# EasyEDA Pro project Foc驱动板.eprj, schematic Schematic2

## Sheets
1 MCU: Board Name: FocDriverV2; Create Date: 2026-02-18; Page Name: MCU; Project Name: Foc驱动板; Schematic Name: Schematic2; Update Date: 2026-02-18; Company: 嘉立创EDA; Page Size: A4; Version: V1.0
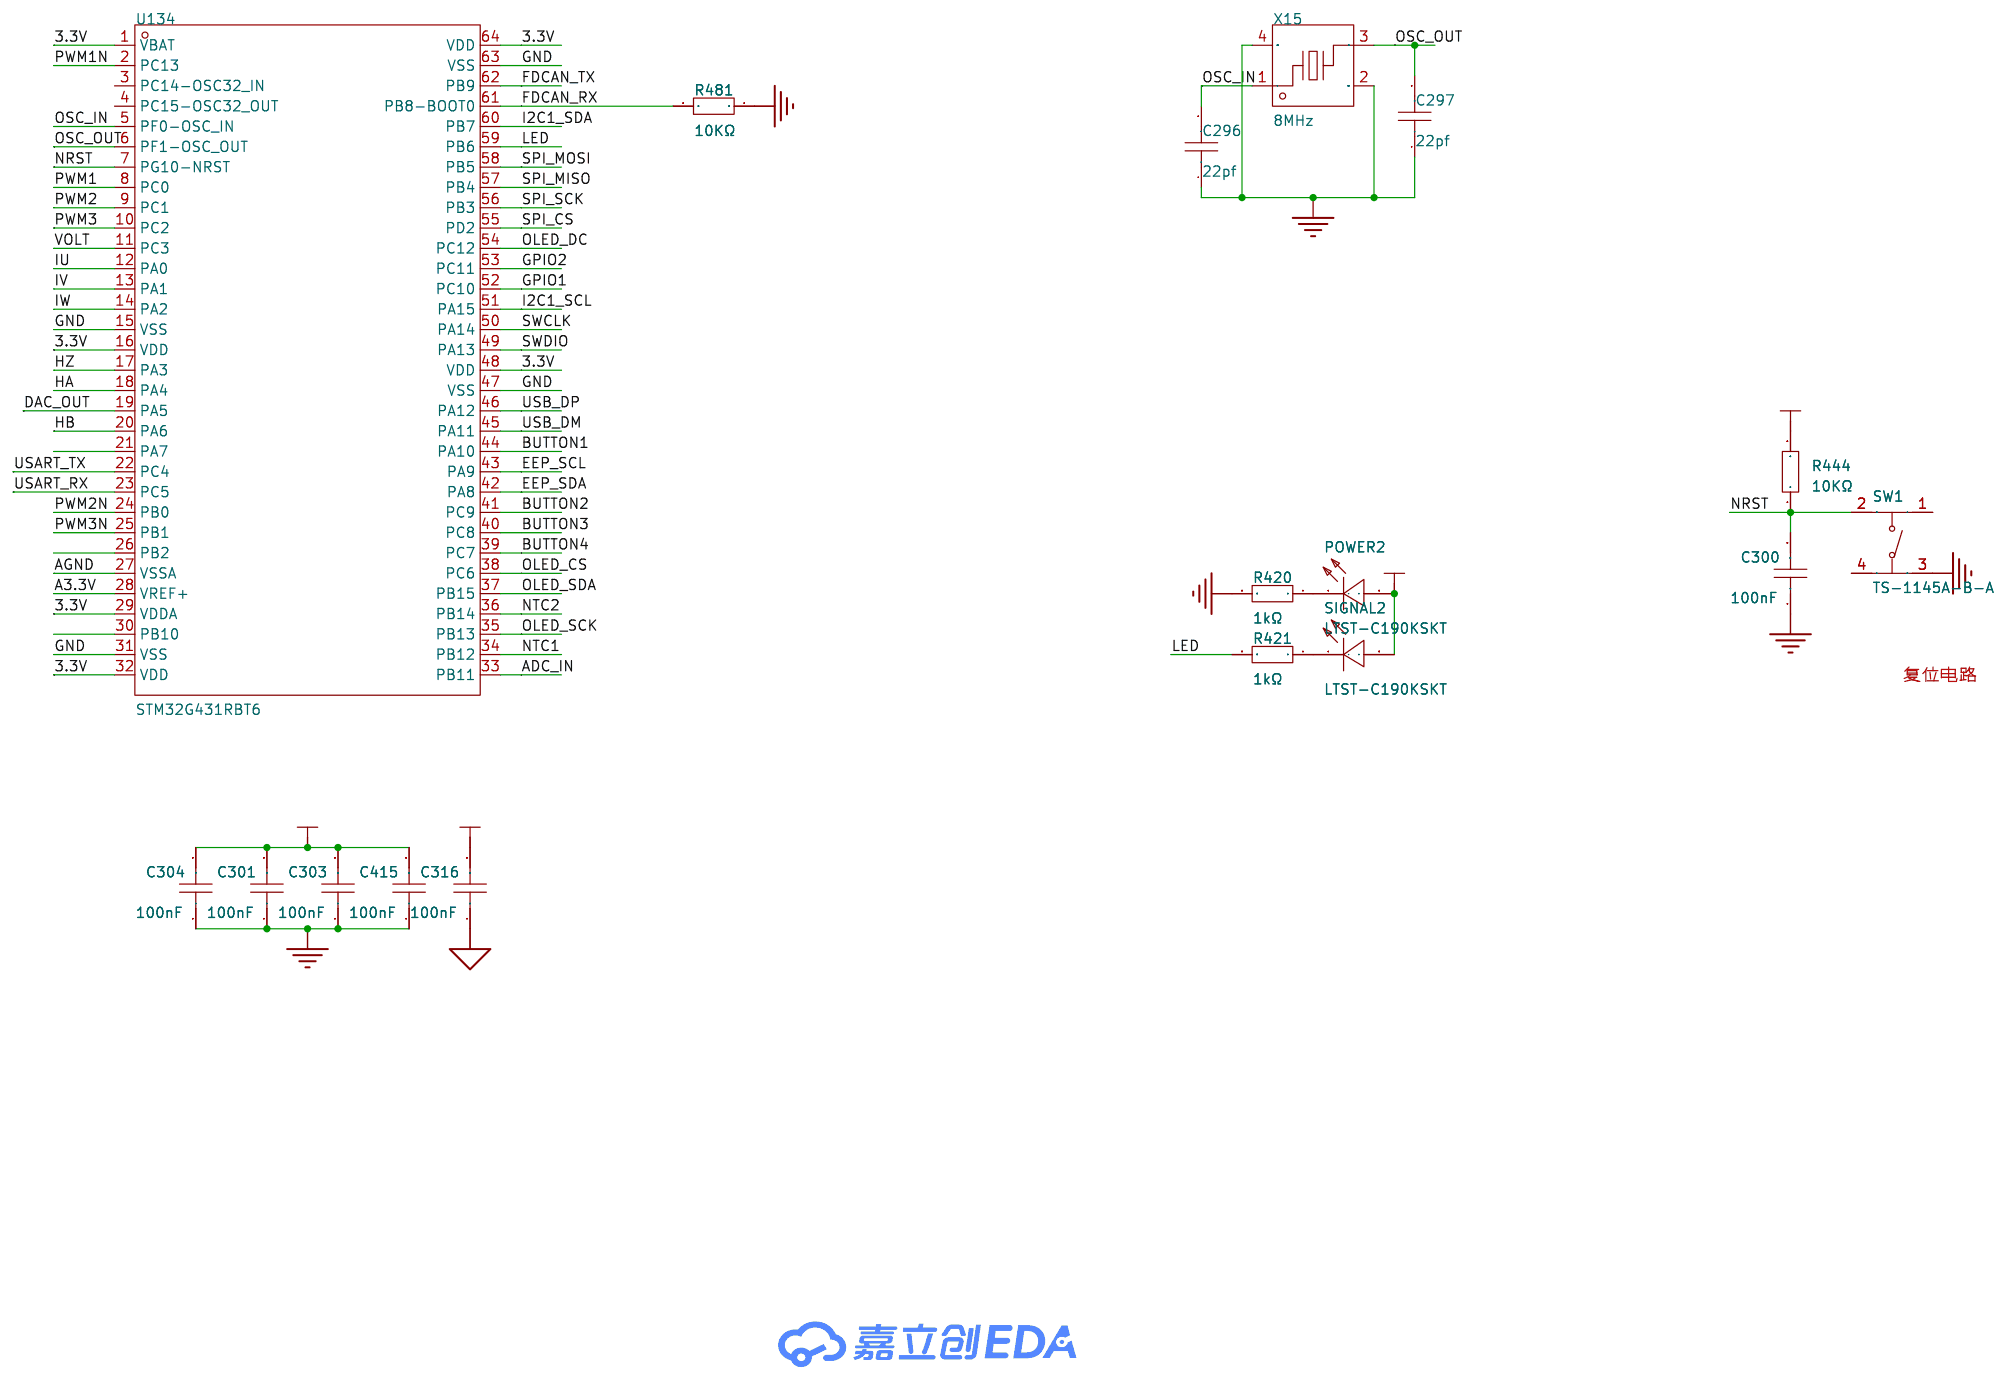
[diagram p3: MCU]
2 逆变电路: Page Name: 逆变电路
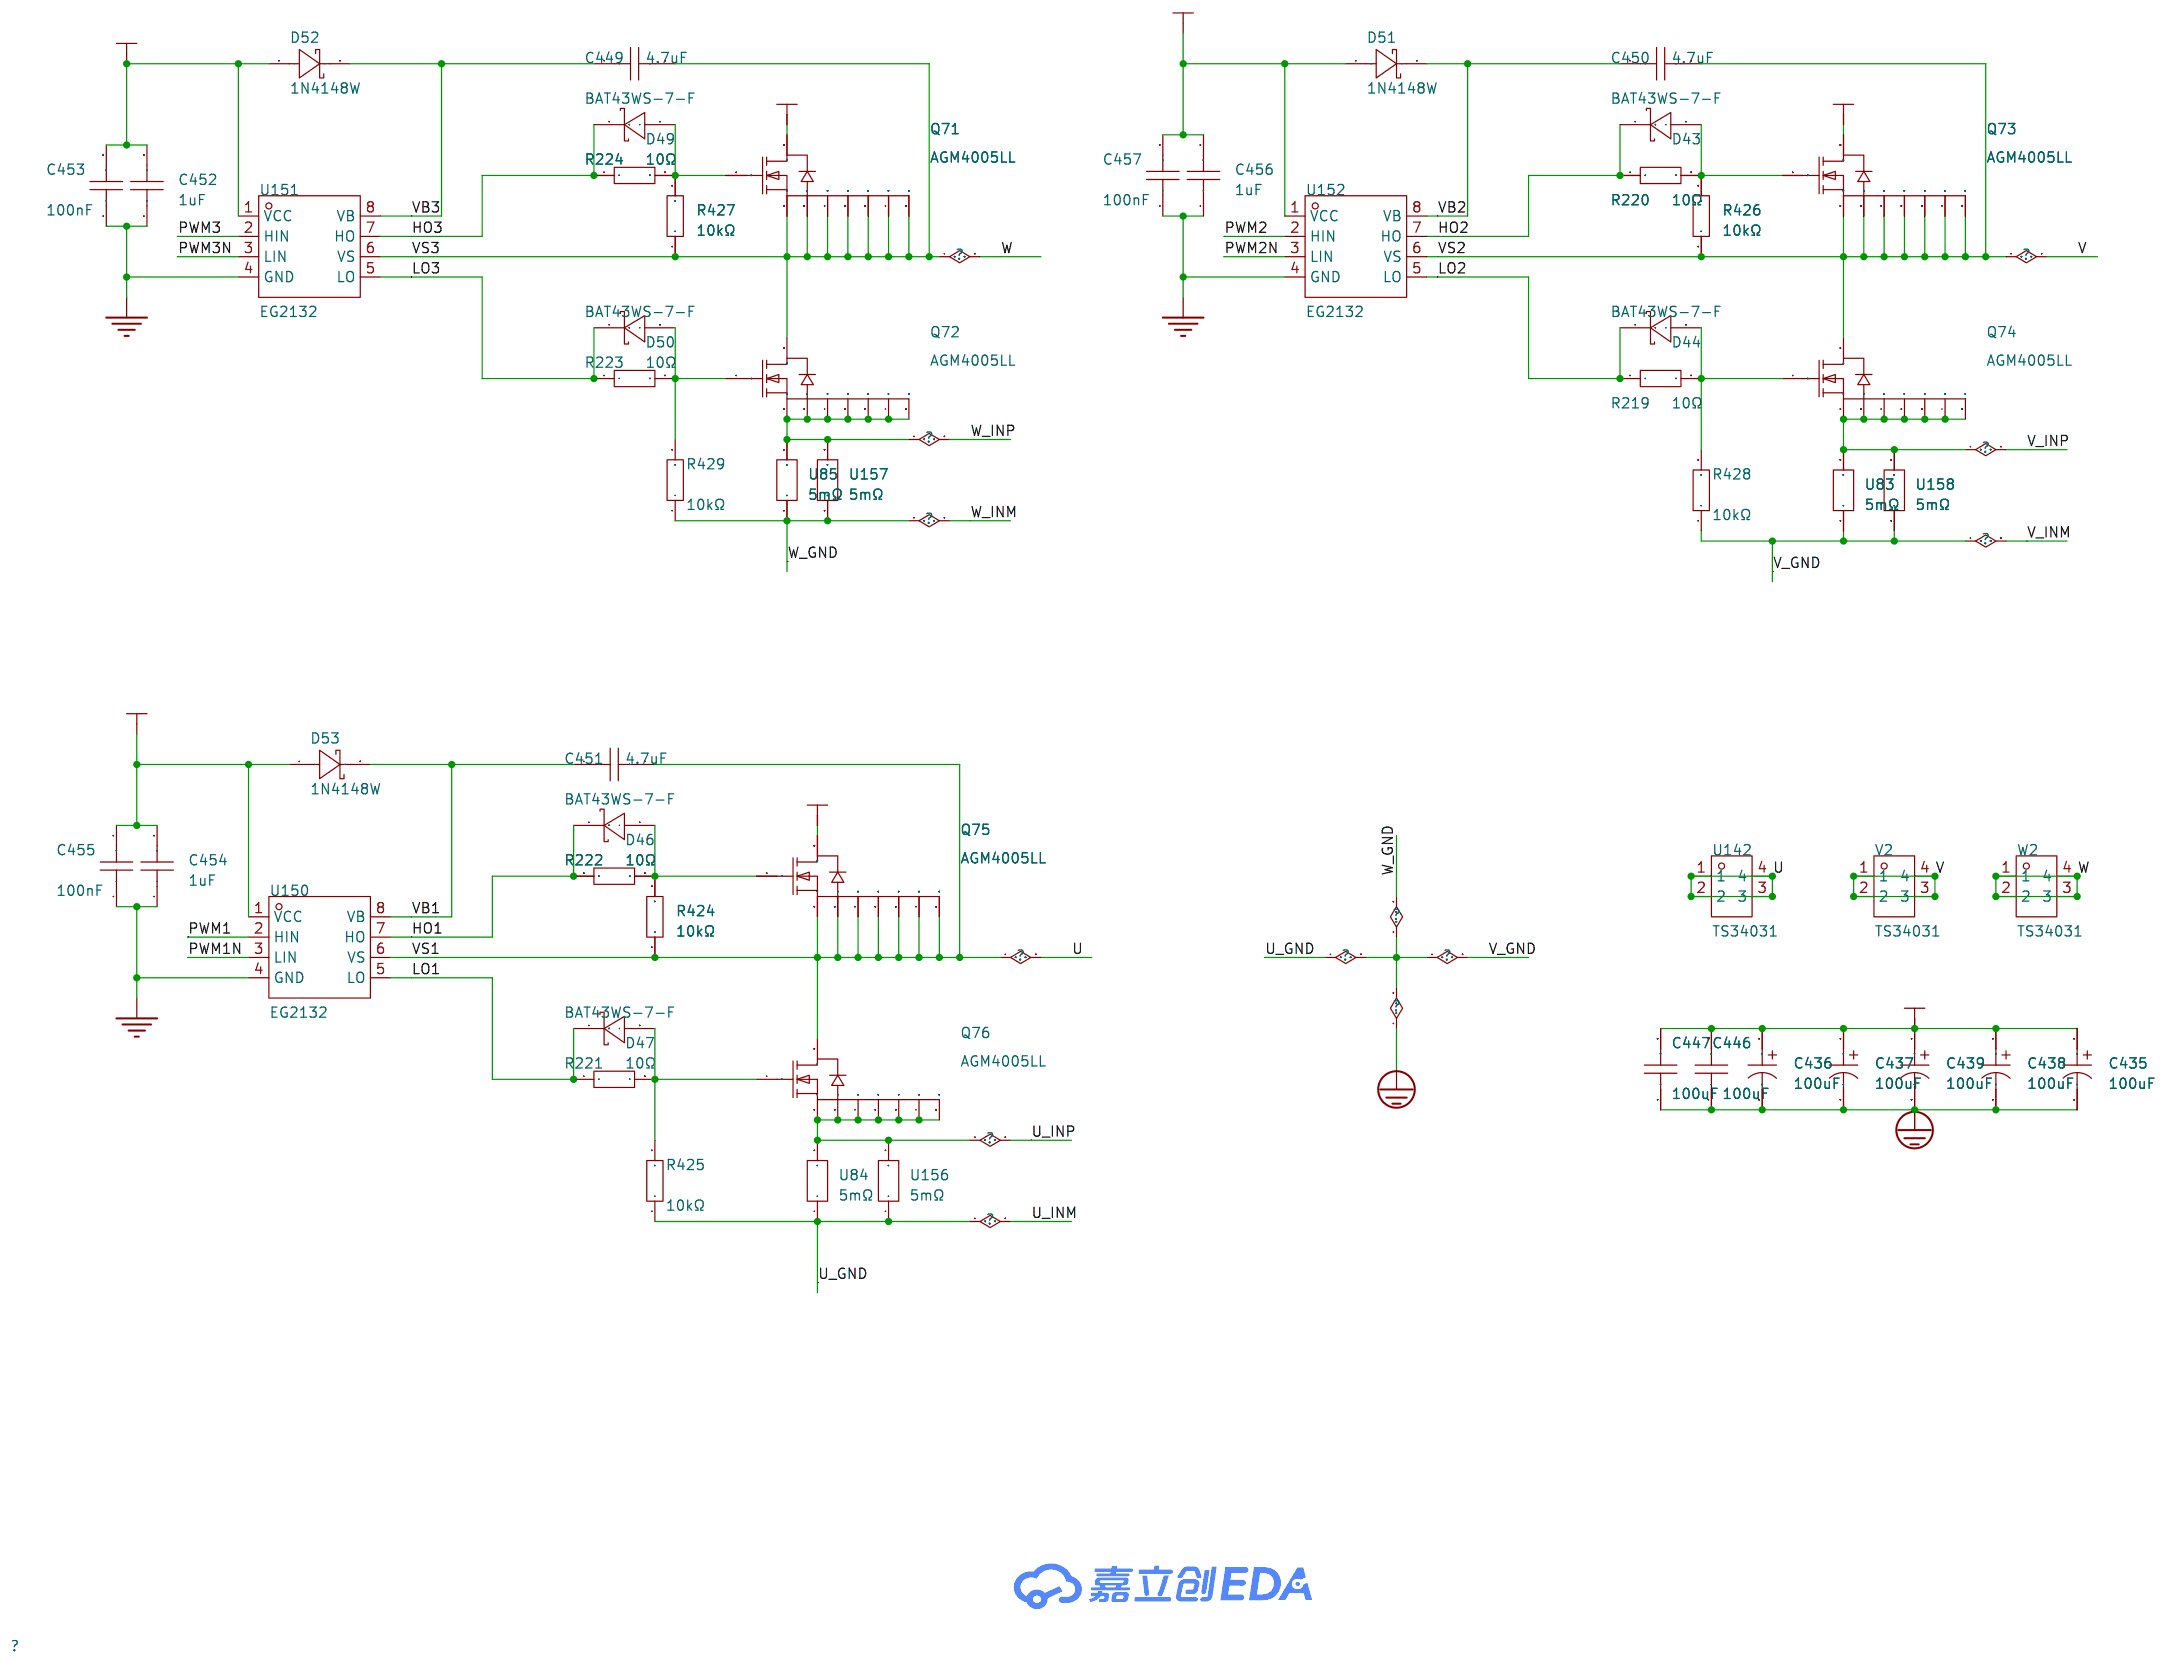
[diagram p4: 逆变电路]
3 采样电路: Page Name: 采样电路
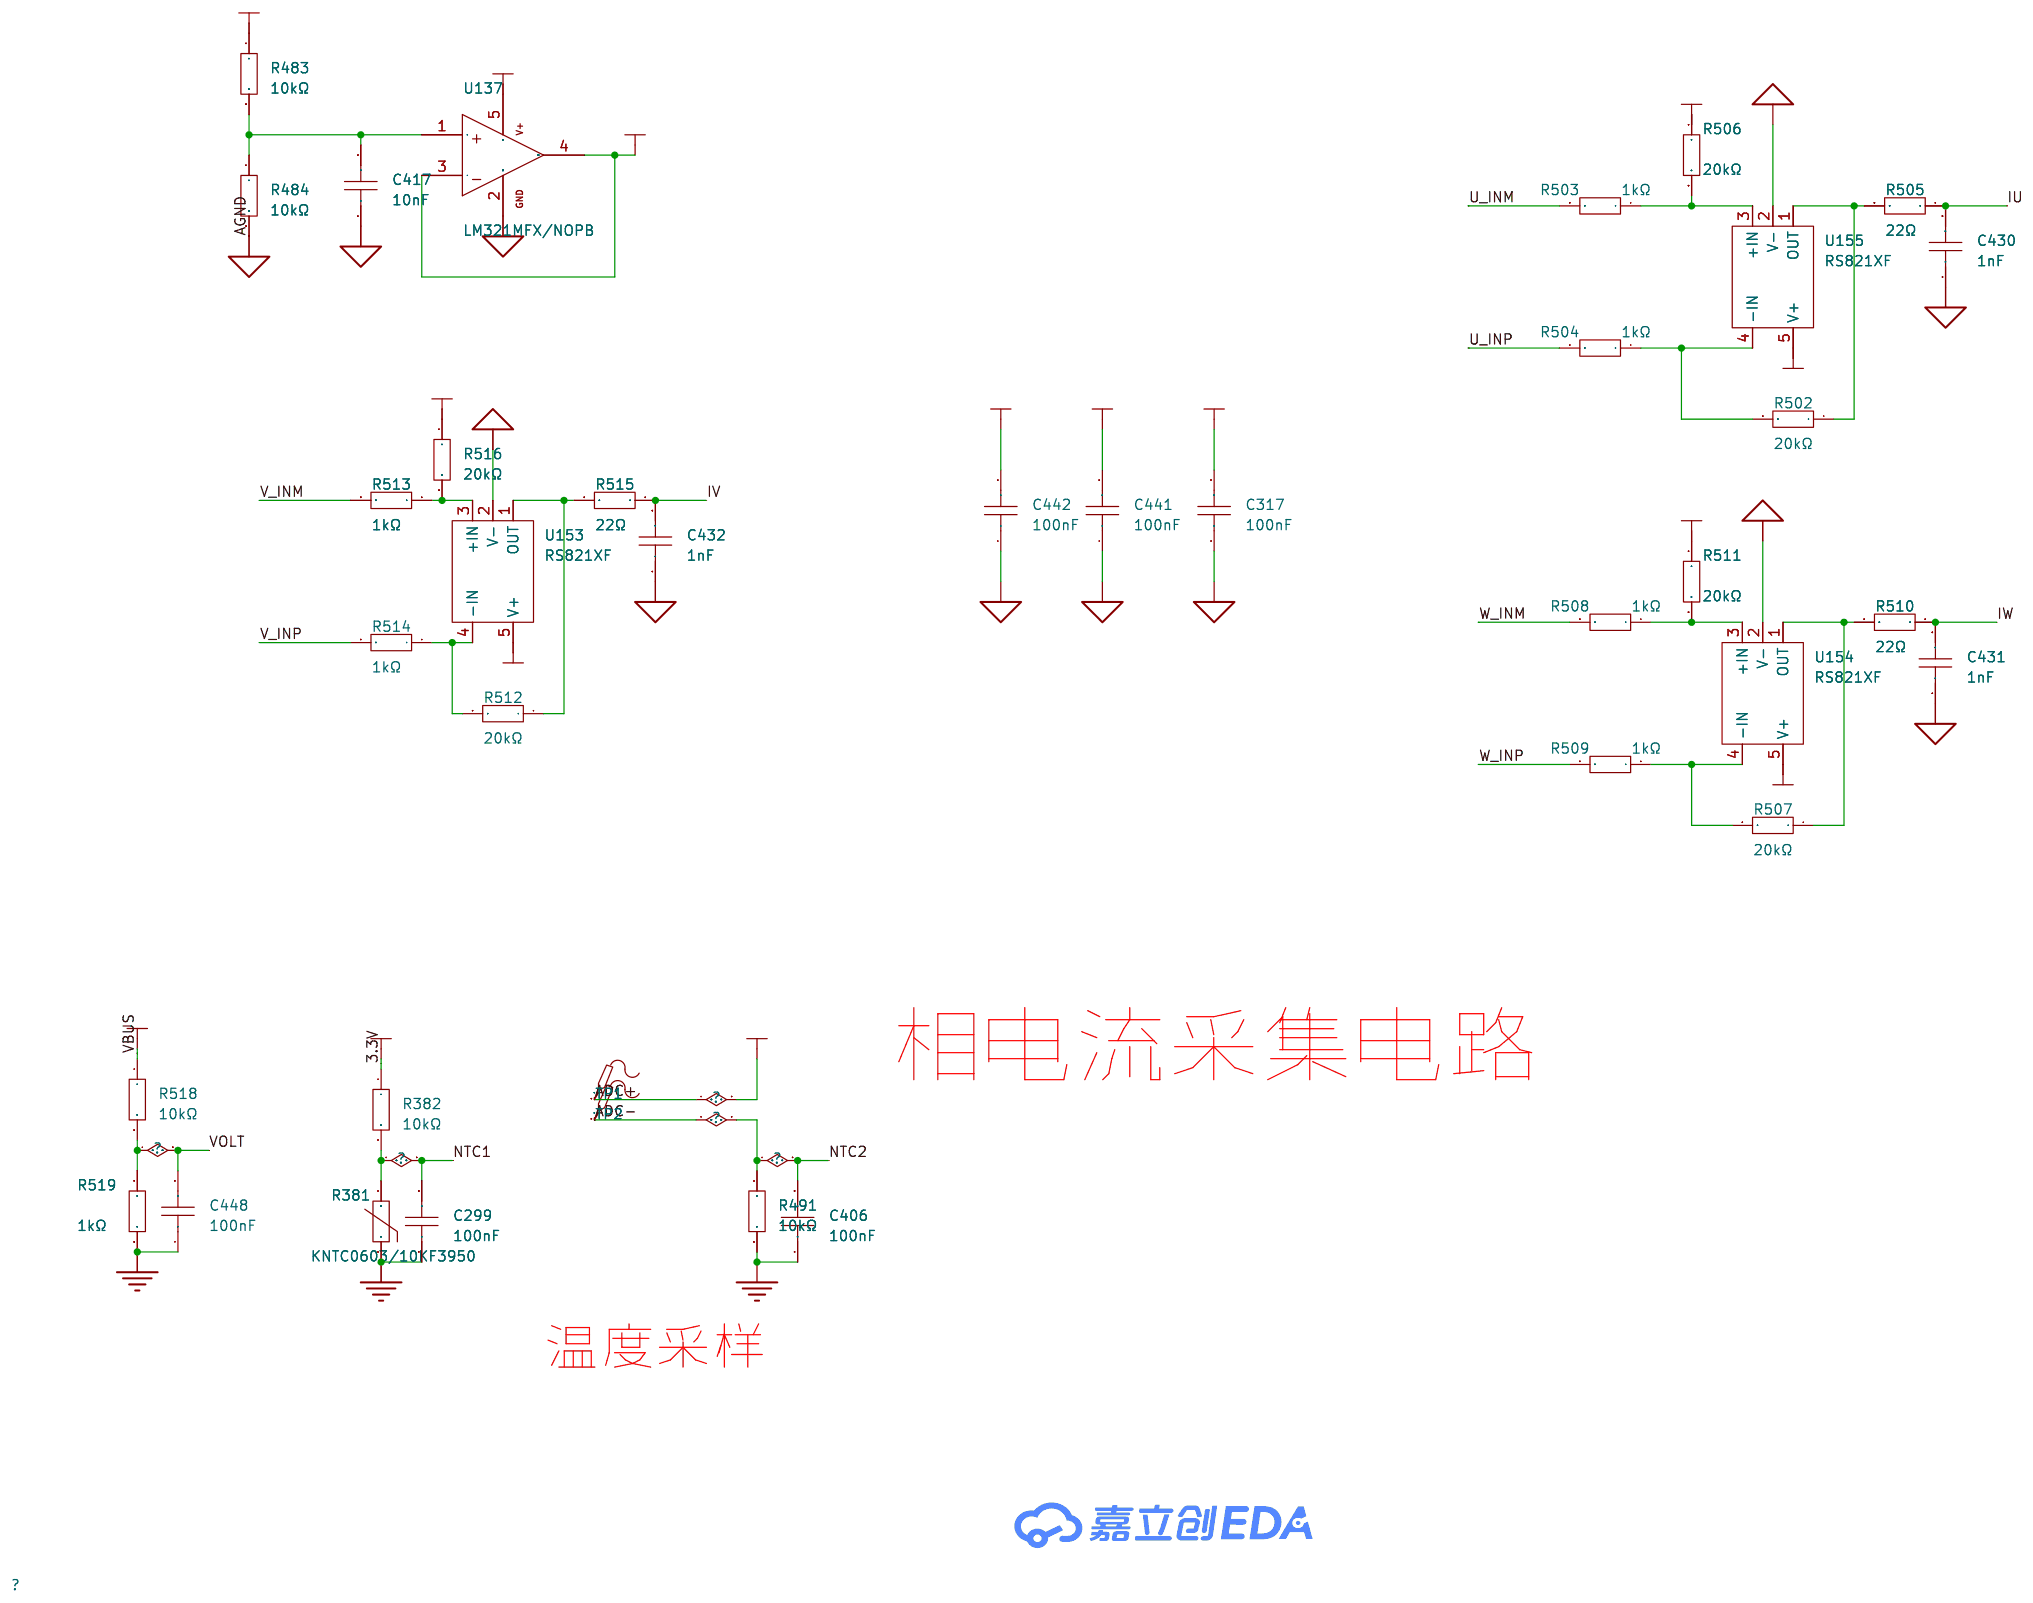
[diagram p5: 采样电路]
4 电源电路: Page Name: 电源电路
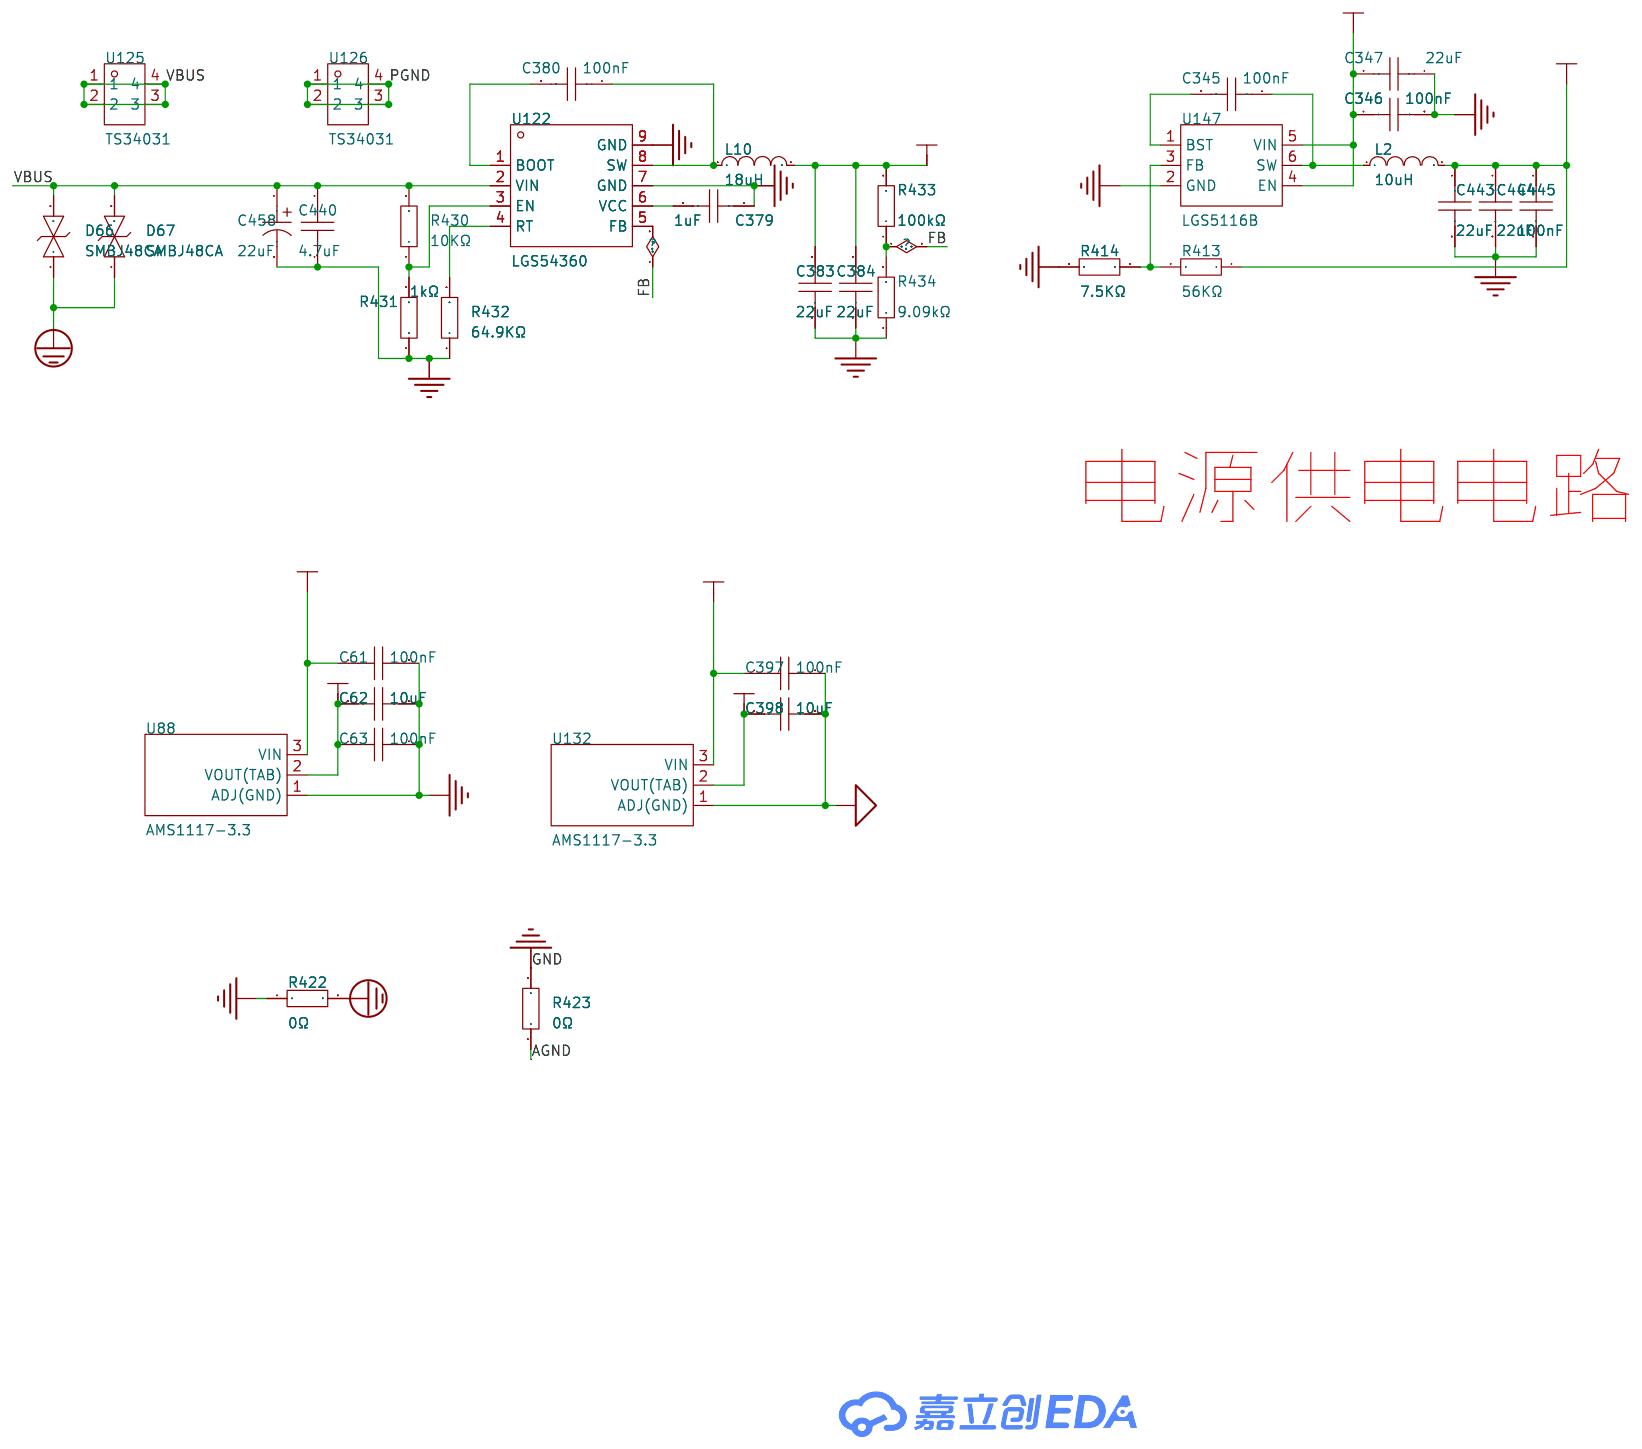
[diagram p6: 电源电路]
5 外设及接口电路: Page Name: 外设及接口电路
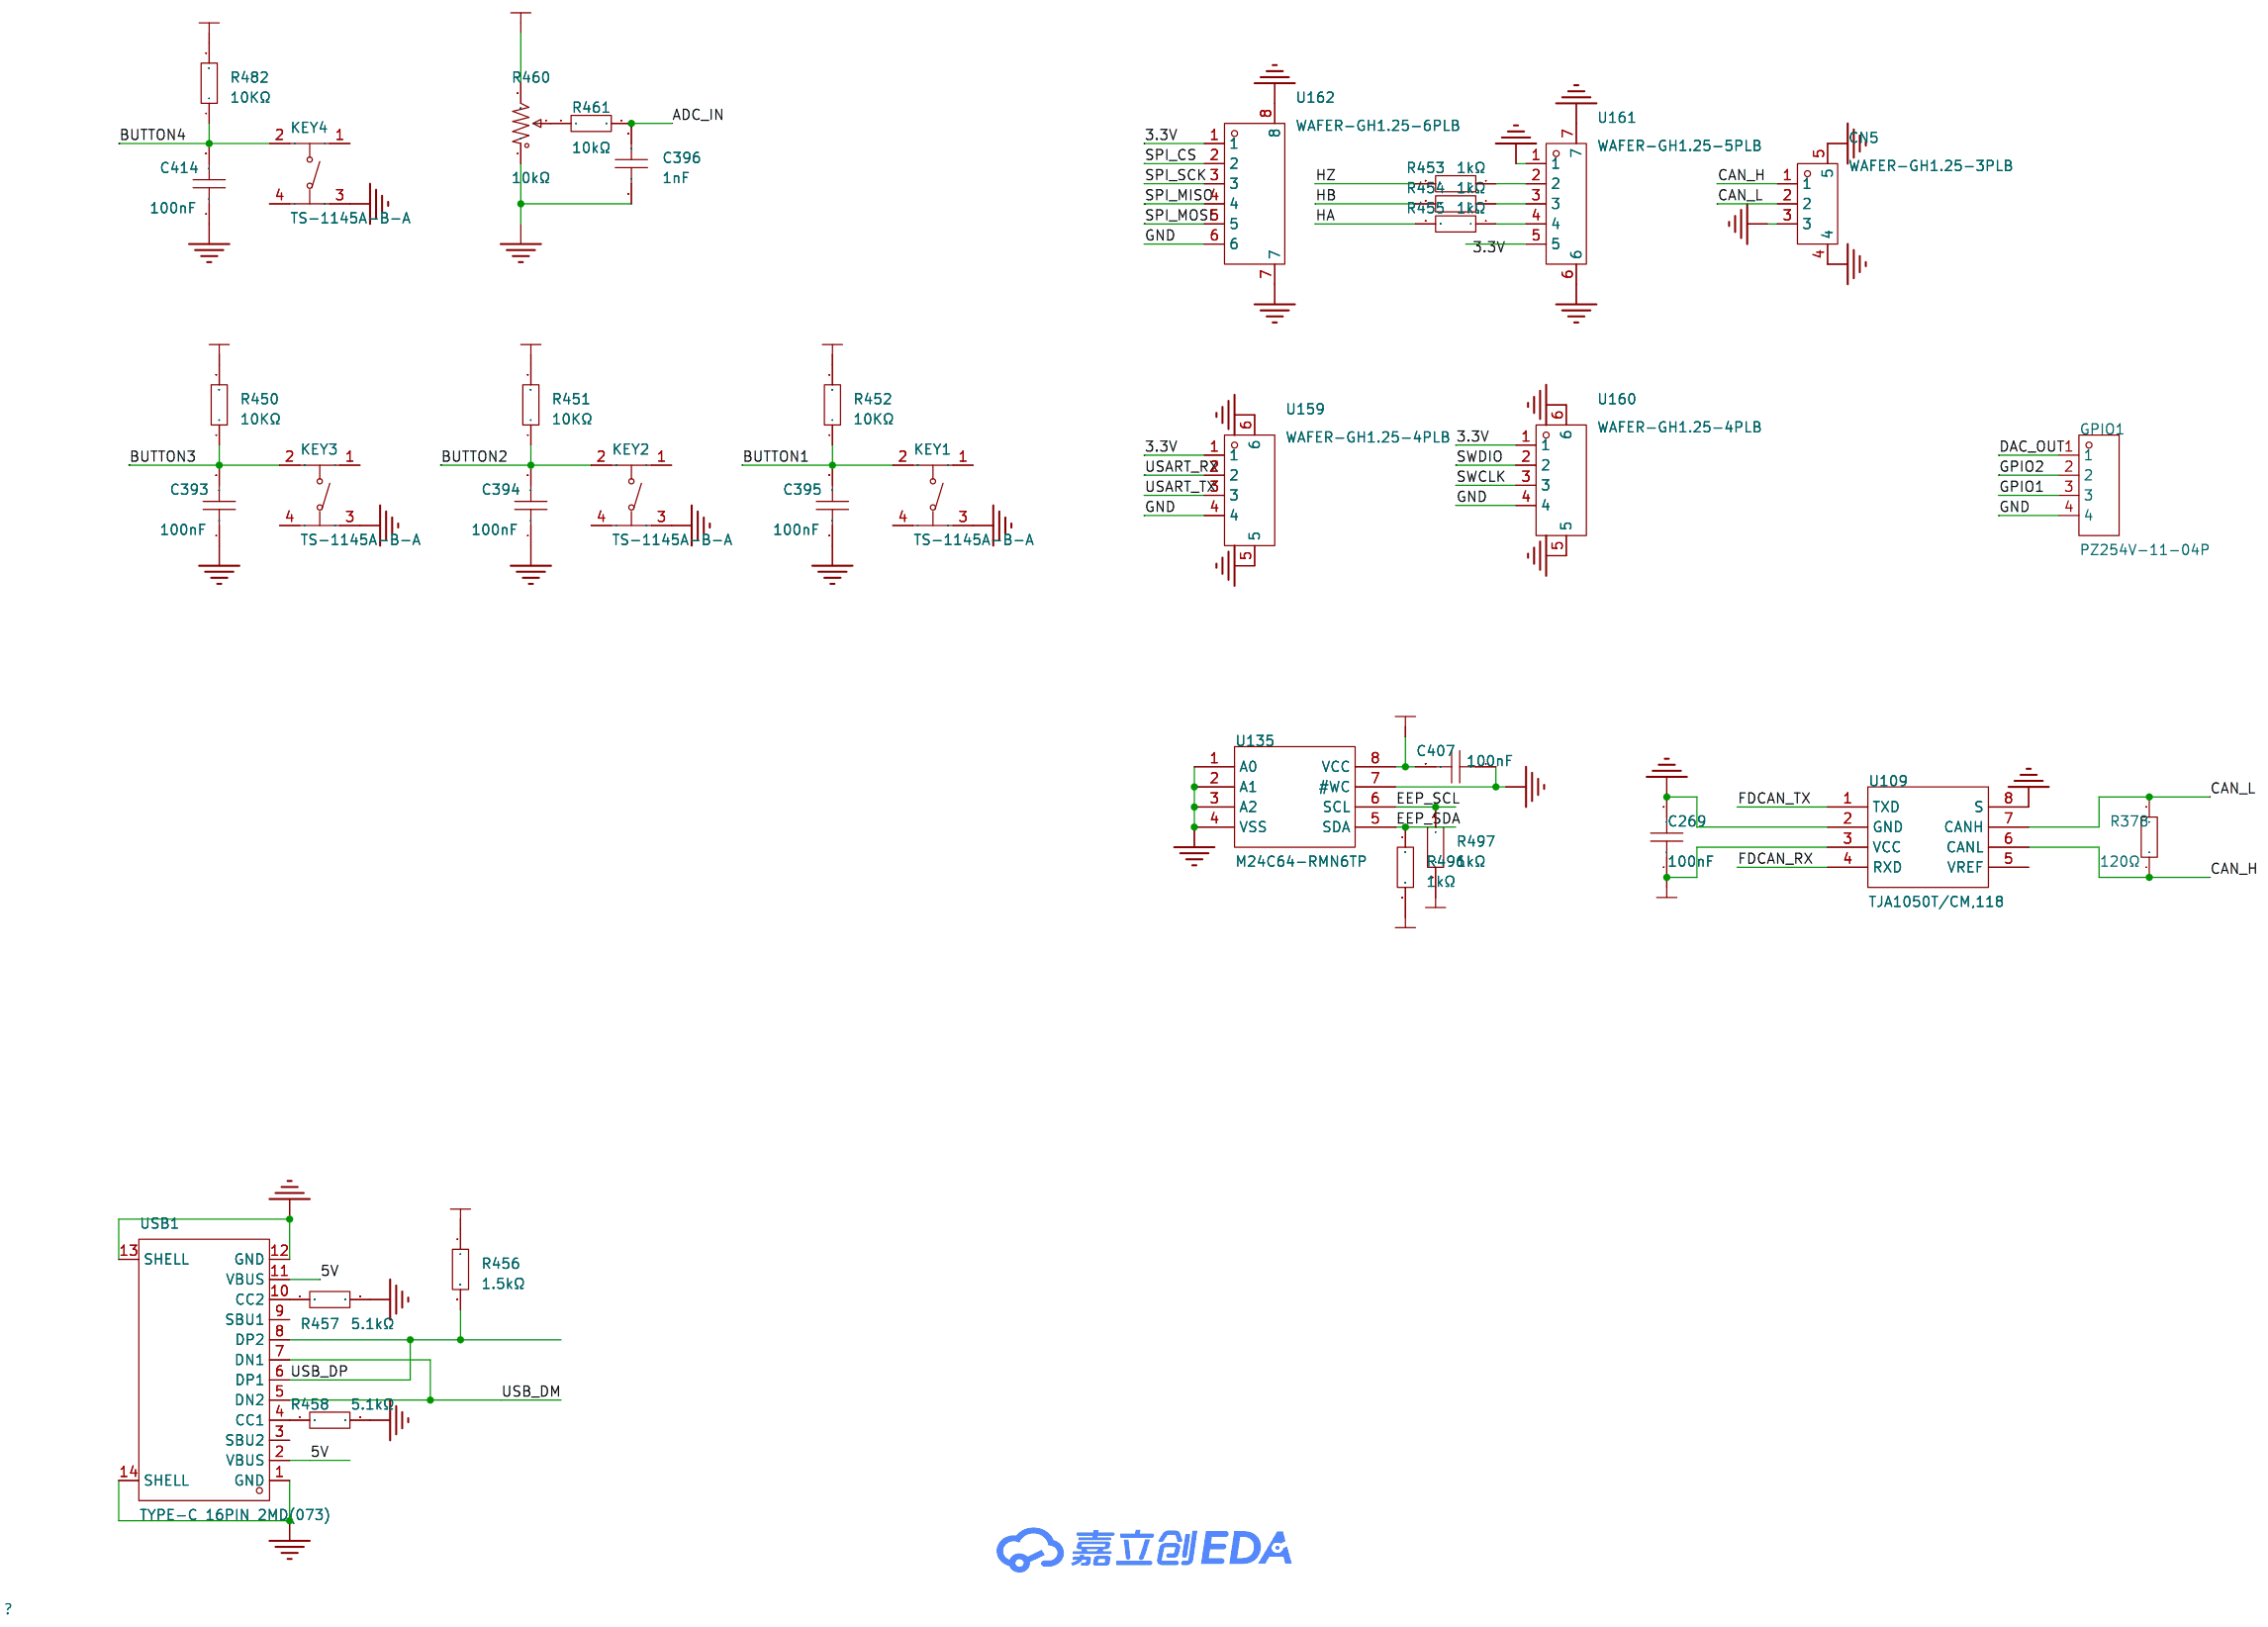
[diagram p7: 外设及接口电路]
